# EasyEDA Pro project Dex_split.eprj, board lets_go (continued)
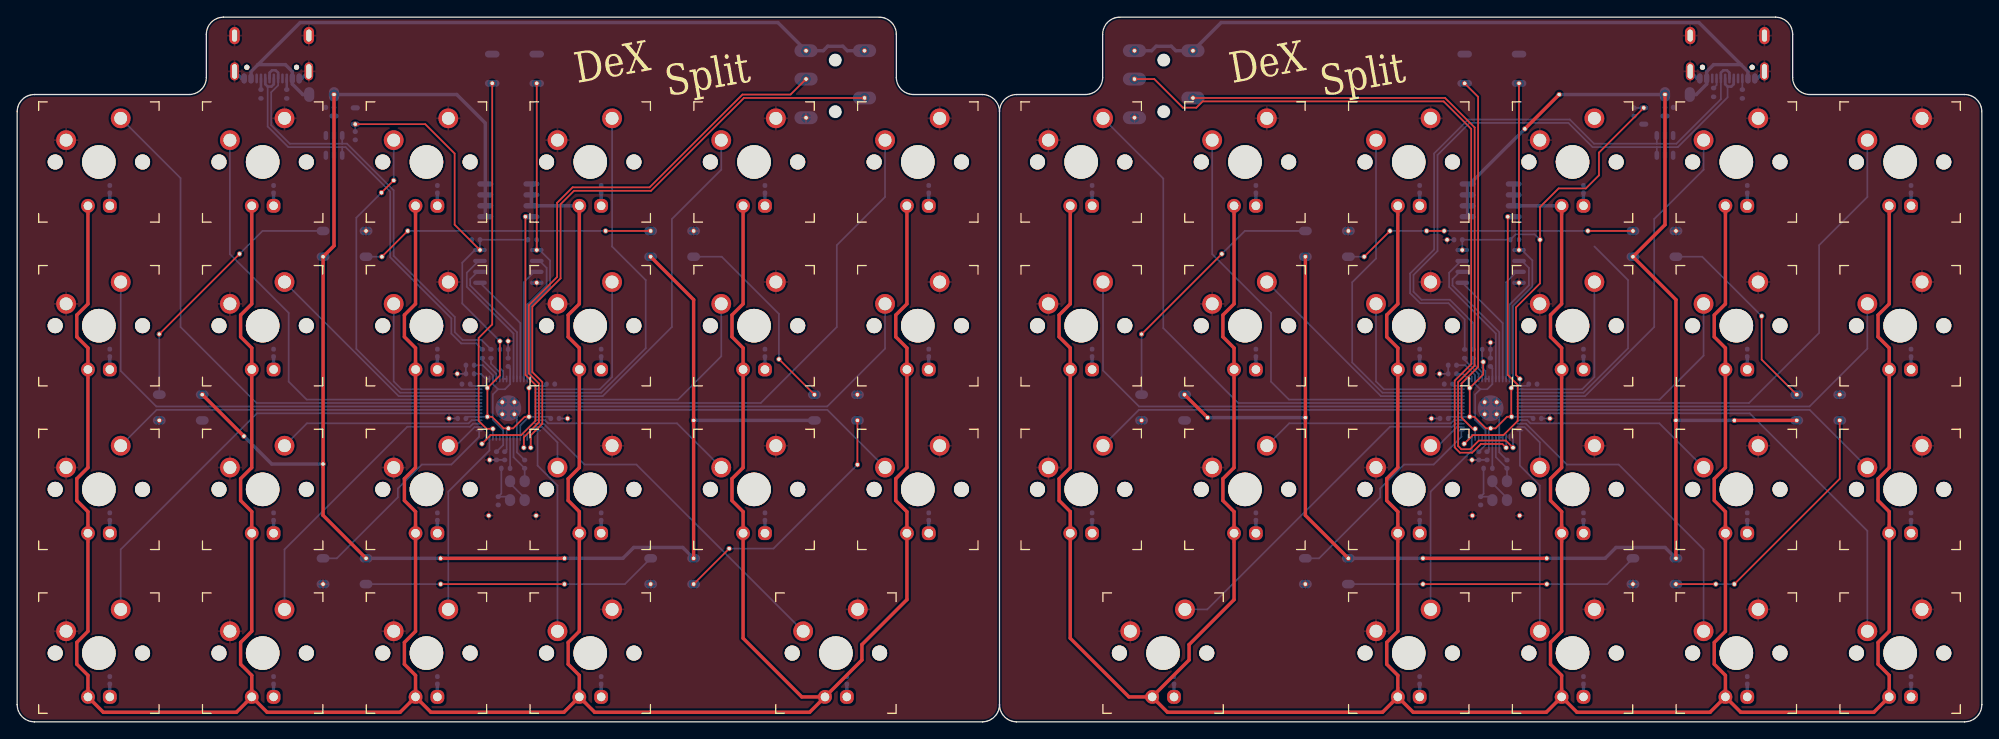
[diagram p0: board, top side]
## Placement (name value [footprint] x y rotation side) (continued)
R40  500Ω  [R0402]  48.87 4.83 270 bottom
R41  500Ω  [R0402]  67.92 4.83 270 bottom
R42  500Ω  [R0402]  96.5 4.83 270 bottom
R50  500Ω  [R0402]  220.27 61.98 270 bottom
R51  500Ω  [R0402]  201.22 61.98 270 bottom
R52  500Ω  [R0402]  182.17 61.98 270 bottom
R53  500Ω  [R0402]  163.12 61.98 270 bottom
R54  500Ω  [R0402]  144.07 61.98 270 bottom
R55  500Ω  [R0402]  125.02 61.98 270 bottom
R56  500Ω  [R0402]  220.27 42.93 270 bottom
R57  500Ω  [R0402]  201.22 42.93 270 bottom
R58  500Ω  [R0402]  182.17 42.93 270 bottom
R59  500Ω  [R0402]  163.12 42.93 270 bottom
R60  500Ω  [R0402]  144.07 42.93 270 bottom
R61  500Ω  [R0402]  125.02 42.93 270 bottom
R62  500Ω  [R0402]  220.27 23.88 270 bottom
R63  500Ω  [R0402]  201.22 23.88 270 bottom
R64  500Ω  [R0402]  182.17 23.88 270 bottom
R65  500Ω  [R0402]  163.12 23.88 270 bottom
R66  500Ω  [R0402]  144.07 23.88 270 bottom
R67  500Ω  [R0402]  125.02 23.88 270 bottom
R68  500Ω  [R0402]  220.27 4.83 270 bottom
R69  500Ω  [R0402]  201.22 4.83 270 bottom
R70  500Ω  [R0402]  182.17 4.83 270 bottom
R71  500Ω  [R0402]  163.12 4.83 270 bottom
R72  500Ω  [R0402]  134.54 4.83 270 bottom
RMX_SW1  -  [CHERRY_MX_MILMAX]  219 65.15 0 top
RMX_SW2  -  [CHERRY_MX_MILMAX]  199.95 65.15 0 top
RMX_SW3  -  [CHERRY_MX_MILMAX]  180.9 65.15 0 top
RMX_SW4  -  [CHERRY_MX_MILMAX]  161.85 65.15 0 top
RMX_SW5  -  [CHERRY_MX_MILMAX]  142.8 65.15 0 top
RMX_SW6  -  [CHERRY_MX_MILMAX]  123.75 65.15 0 top
RMX_SW7  -  [CHERRY_MX_MILMAX]  219 46.1 0 top
RMX_SW8  -  [CHERRY_MX_MILMAX]  199.95 46.1 0 top
RMX_SW9  -  [CHERRY_MX_MILMAX]  180.9 46.1 0 top
RMX_SW10  -  [CHERRY_MX_MILMAX]  161.85 46.1 0 top
RMX_SW11  -  [CHERRY_MX_MILMAX]  142.8 46.1 0 top
RMX_SW12  -  [CHERRY_MX_MILMAX]  123.75 46.1 0 top
RMX_SW13  -  [CHERRY_MX_MILMAX]  219 27.05 0 top
RMX_SW14  -  [CHERRY_MX_MILMAX]  199.95 27.05 0 top
RMX_SW15  -  [CHERRY_MX_MILMAX]  180.9 27.05 0 top
RMX_SW16  -  [CHERRY_MX_MILMAX]  161.85 27.05 0 top
RMX_SW17  -  [CHERRY_MX_MILMAX]  142.8 27.05 0 top
RMX_SW18  -  [CHERRY_MX_MILMAX]  123.75 27.05 0 top
RMX_SW19  -  [CHERRY_MX_MILMAX]  219 8 0 top
RMX_SW20  -  [CHERRY_MX_MILMAX]  199.95 8 0 top
RMX_SW21  -  [CHERRY_MX_MILMAX]  180.9 8 0 top
RMX_SW22  -  [CHERRY_MX_MILMAX]  161.85 8 0 top
RMX_SW23  -  [CHERRY_MX_MILMAX]  133.28 8 0 top
S1  B3U-1000P  [KEY-SMD_B3U-1000PM]  60.42 76 270 bottom
S2  B3U-1000P  [KEY-SMD_B3U-1000PM]  55.25 76 270 bottom
S3  B3U-1000P  [KEY-SMD_B3U-1000PM]  174.68 76 270 bottom
S4  B3U-1000P  [KEY-SMD_B3U-1000PM]  168.35 76 270 bottom
U1  RP2040  [LQFN-56_L7.0-W7.0-P0.4-EP]  171.38 36.5 180 bottom
U2  XC6206P332MR-G  [SOT-23-3_L2.9-W1.6-P1.90-LS2.8-BR]  190.41 70.5 180 bottom
U3  SRV05-4  [SOT-23-6_L2.9-W1.6-P0.95-LS2.8-BL]  191.65 67.08 180 bottom
U4  W25Q128JVSIQ  [SOIC-8_L5.3-W5.3-P1.27-LS8.0-BL]  171.38 53 270 bottom
U5  RP2040  [LQFN-56_L7.0-W7.0-P0.4-EP]  57.12 36.5 180 bottom
U6  SRV05-4  [SOT-23-6_L2.9-W1.6-P0.95-LS2.8-BL]  36.85 67.08 180 bottom
U7  XC6206P332MR-G  [SOT-23-3_L2.9-W1.6-P1.90-LS2.8-BR]  38.08 70.5 0 bottom
U8  W25Q128JVSIQ  [SOIC-8_L5.3-W5.3-P1.27-LS8.0-BL]  57.12 53 270 bottom
Y1  12MHz  [CRYSTAL-SMD_4P-L3.2-W2.5-BL]  58.17 26.9 90 bottom
Y2  12MHz  [CRYSTAL-SMD_4P-L3.2-W2.5-BL]  172.43 26.9 90 bottom

## Footprints (pads in the part's own frame, mm; a bottom-side part is the same pattern mirrored in y, then rotated)
AUDIO-SMD_KH-PJ-327F-SMT
  rrect 1.5x2.7 smd: A(-3.9,3.4) B(-3.9,-3.4) C(1.6,-3.4) D(-0.6,3.4) E(3.9,3.4)
Capacitor_SMD:C_0402_1005Metric
  rrect 0.56x0.62 smd: 1(-0.48,0) 2(0.48,0)
CHERRY_MX_MILMAX
  round 1.75 hole 1.75: 1(-5.08,0) 2(5.08,0)
  round 3.9 hole 3.9: 3(0,0)
  round 2.3 hole 1.5: 4(2.54,5.08) 5(-3.81,2.54)
  round 1.6 hole 1: 6(-1.27,-5.1)
  rrect 1.6x1.6 hole 1: 7(1.27,-5.1)
Connector_USB:USB_C_Receptacle_Palconn_UTC16-G
  round 0.6 hole 0.6: (-2.89,1.33) (2.89,1.33)
  rrect 0.6x1.16 smd: A1(-3.2,2.63) A4(-2.4,2.63) A9(2.4,2.63) A12(3.2,2.63) B1(3.2,2.63) B9(-2.4,2.63) B9(2.4,2.63) B12(-3.2,2.63)
  rrect 0.3x1.16 smd: A5(-1.25,2.63) A6(-0.25,2.63) A7(0.25,2.63) A8(1.25,2.63) B5(1.75,2.63) B6(0.75,2.63) B7(-0.75,2.63) B8(-1.75,2.63)
  oval 1.2x2 hole 0.6x1.4: S1(-4.32,-2.36) S1(4.32,-2.36)
  oval 1x2.1 hole 0.6x1.7: S1(-4.32,1.81) S1(4.32,1.81)
CRYSTAL-SMD_4P-L3.2-W2.5-BL
  rrect 1.4x1.2 smd: 1(-1.1,-0.85) 2(1.1,-0.85) 3(1.1,0.85) 4(-1.1,0.85)
F1206
  rrect 1.19x1.728 smd: 1(-1.445,0) 2(1.445,0)
KEY-SMD_B3U-1000PM
  rrect 0.8x1.7 smd: 1(-1.7,0) 2(1.7,0)
LED-SMD_4P-L5.0-W5.0-BL_XL-5050RGBC
  rrect 1x1.5 smd: 1(-1.5,-2.5) 2(1.5,-2.5) 3(1.5,2.5) 4(-1.5,2.5)
LQFN-56_L7.0-W7.0-P0.4-EP
  rrect 0.8x0.2 smd: 1(-3.4,2.6) 2(-3.4,2.2) 3(-3.4,1.8) 4(-3.4,1.4) 5(-3.4,1) 6(-3.4,0.6) 7(-3.4,0.2) 8(-3.4,-0.2) 9(-3.4,-0.6) 10(-3.4,-1) 11(-3.4,-1.4) 12(-3.4,-1.8) 13(-3.4,-2.2) 14(-3.4,-2.6) 29(3.4,-2.6) 30(3.4,-2.2) 31(3.4,-1.8) 32(3.4,-1.4) 33(3.4,-1) 34(3.4,-0.6) 35(3.4,-0.2) 36(3.4,0.2) 37(3.4,0.6) 38(3.4,1) 39(3.4,1.4) 40(3.4,1.8) 41(3.4,2.2) 42(3.4,2.6)
  rrect 0.2x0.8 smd: 15(-2.6,-3.4) 16(-2.2,-3.4) 17(-1.8,-3.4) 18(-1.4,-3.4) 19(-1,-3.4) 20(-0.6,-3.4) 21(-0.2,-3.4) 22(0.2,-3.4) 23(0.6,-3.4) 24(1,-3.4) 25(1.4,-3.4) 26(1.8,-3.4) 27(2.2,-3.4) 28(2.6,-3.4) 43(2.6,3.4) 44(2.2,3.4) 45(1.8,3.4) 46(1.4,3.4) 47(1,3.4) 48(0.6,3.4) 49(0.2,3.4) 50(-0.2,3.4) 51(-0.6,3.4) 52(-1,3.4) 53(-1.4,3.4) 54(-1.8,3.4) 55(-2.2,3.4) 56(-2.6,3.4)
  rrect 3x3 smd: 57(0,0)
Pad_e56
  round 0.6 hole 0.4: 1(0,0)
Pad_e57
  round 0.6 hole 0.4: 2(0,0)
Pad_e58
  round 0.6 hole 0.4: 3(0,0)
Pad_e59
  round 0.6 hole 0.4: 4(0,0)
Pad_e60
  round 0.6 hole 0.4: 1(0,0)
Pad_e61
  round 0.6 hole 0.4: 2(0,0)
Pad_e62
  round 0.6 hole 0.4: 3(0,0)
Pad_e63
  round 0.6 hole 0.4: 4(0,0)
Pad_e65
  round 0.6 hole 0.4: 1(0,0)
Pad_e66
  round 0.6 hole 0.4: 2(0,0)
Pad_e75
  round 0.6 hole 0.4: 5(0,0)
Pad_e76
  round 0.6 hole 0.4: 6(0,0)
Pad_e77
  round 0.6 hole 0.4: 7(0,0)
Pad_e78
  round 0.6 hole 0.4: 8(0,0)
Pad_e79
  round 0.6 hole 0.4: 9(0,0)
Pad_e80
  round 0.6 hole 0.4: 10(0,0)
Pad_e81
  round 0.6 hole 0.4: 11(0,0)
Pad_e84
  round 0.6 hole 0.4: 12(0,0)
Pad_e88
  round 0.6 hole 0.4: 1(0,0)
Pad_e187
  round 0.6 hole 0.4: 1(0,0)
Pad_e204
  round 0.6 hole 0.4: 1(0,0)
Pad_e280
  round 0.6 hole 0.4: 1(0,0)
Pad_e307
  round 0.6 hole 0.4: 1(0,0)
Pad_e310
  round 0.6 hole 0.4: 4(0,0)
Pad_e314
  round 0.6 hole 0.4: 1(0,0)
Pad_e331
  round 0.6 hole 0.4: 1(0,0)
Pad_e333
  round 0.6 hole 0.4: 1(0,0)
Pad_e335
  round 0.6 hole 0.4: 1(0,0)
Pad_e339
  round 0.6 hole 0.4: 1(0,0)
Pad_e340
  round 0.6 hole 0.4: 2(0,0)
Pad_e341
  round 0.6 hole 0.4: 1(0,0)
Pad_e343
  round 0.6 hole 0.4: 3(0,0)
Pad_e344
  round 0.6 hole 0.4: 1(0,0)
Pad_e345
  round 0.6 hole 0.4: 1(0,0)
Pad_e346
  round 0.6 hole 0.4: 4(0,0)
Pad_e348
  round 0.6 hole 0.4: 5(0,0)
Pad_e352
  round 0.6 hole 0.4: 6(0,0)
Pad_e353
  round 0.6 hole 0.4: 7(0,0)
Pad_e354
  round 0.6 hole 0.4: 8(0,0)
Pad_e355
  round 0.6 hole 0.4: 9(0,0)
Pad_e357
  round 0.6 hole 0.4: 1(0,0)
Pad_e359
  round 0.6 hole 0.4: 1(0,0)
Pad_e360
  round 0.6 hole 0.4: 2(0,0)
Pad_e361
  round 0.6 hole 0.4: 1(0,0)
Pad_e362
  round 0.6 hole 0.4: 2(0,0)
Pad_e367
  round 0.6 hole 0.4: 1(0,0)
Pad_e374
  round 0.6 hole 0.4: 4(0,0)
Pad_e375
  round 0.6 hole 0.4: 2(0,0)
Pad_e376
  round 0.6 hole 0.4: 1(0,0)
Pad_e377
  round 0.6 hole 0.4: 3(0,0)
Pad_e381
  round 0.6 hole 0.4: 1(0,0)
Pad_e427
  round 0.6 hole 0.4: 1(0,0)
Pad_e460
  round 0.6 hole 0.4: 1(0,0)
Pad_e500
  round 0.6 hole 0.4: 1(0,0)
Pad_e572
  round 0.6 hole 0.4: 1(0,0)
Pad_e574
  round 0.6 hole 0.4: 2(0,0)
Pad_e597
  round 0.6 hole 0.4: 1(0,0)
Pad_e614
  round 0.6 hole 0.4: 4(0,0)
Pad_e615
  round 0.6 hole 0.4: 1(0,0)
Pad_e616
  round 0.6 hole 0.4: 1(0,0)
Pad_e618
  round 0.6 hole 0.4: 2(0,0)
Pad_e619
  round 0.6 hole 0.4: 3(0,0)
Pad_e621
  round 0.6 hole 0.4: 1(0,0)
Pad_e656
  round 0.6 hole 0.4: 1(0,0)
Pad_e802
  round 0.6 hole 0.4: 1(0,0)
Pad_e819
  round 0.6 hole 0.4: 1(0,0)
Pad_e820
  round 0.6 hole 0.4: 2(0,0)
Pad_e832
  round 0.6 hole 0.4: 2(0,0)
Pad_e848
  round 0.6 hole 0.4: 1(0,0)
Pad_e849
  round 0.6 hole 0.4: 2(0,0)
Pad_e870
  round 0.6 hole 0.4: 1(0,0)
Pad_e885
  round 0.6 hole 0.36: 1(0,0)
Pad_e988
  round 0.6 hole 0.4: 1(0,0)
Pad_e1288
  round 0.6 hole 0.4: 1(0,0)
Pad_e1300
  round 0.6 hole 0.4: 1(0,0)
Pad_e1359
  round 0.6 hole 0.4: 1(0,0)
Pad_e1412
  round 0.6 hole 0.4: 1(0,0)
Pad_e1417
  round 0.6 hole 0.4: 1(0,0)
Pad_e1443
  round 0.6 hole 0.4: 1(0,0)
Pad_e1468
  round 0.6 hole 0.4: 1(0,0)
Pad_e1560
  round 0.6 hole 0.4: 1(0,0)
Pad_e1562
  round 0.6 hole 0.4: 1(0,0)
Pad_e1563
  round 0.6 hole 0.4: 2(0,0)
Pad_e1674
  round 0.6 hole 0.4: 1(0,0)
Pad_e1687
  round 0.6 hole 0.4: 1(0,0)
Pad_e1703
  round 0.6 hole 0.4: 1(0,0)
Pad_e1706
  round 0.6 hole 0.4: 1(0,0)
Pad_e1708
  round 0.6 hole 0.4: 4(0,0)
Pad_e1715
  round 0.6 hole 0.4: 1(0,0)
Pad_e1744
  round 0.6 hole 0.4: 1(0,0)
Pad_e1745
  round 0.6 hole 0.4: 2(0,0)
Pad_e1749
  round 0.6 hole 0.4: 1(0,0)
Pad_e1750
  round 0.6 hole 0.4: 2(0,0)
Pad_e1764
  round 0.6 hole 0.4: 1(0,0)
Pad_e1796
  round 0.6 hole 0.4: 1(0,0)
Pad_e1802
  round 0.6 hole 0.4: 1(0,0)
Pad_e1814
  round 0.6 hole 0.4: 1(0,0)
Pad_e1864
  round 0.6 hole 0.4: 1(0,0)
Pad_e1868
  round 0.6 hole 0.4: 1(0,0)
Pad_e1871
  round 0.6 hole 0.36: 1(0,0)
Pad_e1880
  round 0.6 hole 0.4: 1(0,0)
Pad_e1893
  round 0.6 hole 0.4: 1(0,0)
Pad_e1901
  round 0.6 hole 0.4: 2(0,0)
Pad_e1903
  round 0.6 hole 0.4: 1(0,0)
Pad_e1905
  round 0.6 hole 0.4: 2(0,0)
Pad_e1923
  round 0.6 hole 0.4: 1(0,0)
Pad_e1930
  round 0.6 hole 0.4: 2(0,0)
Pad_e2258
  round 0.6 hole 0.4: 1(0,0)
Pad_e2261
  round 0.6 hole 0.4: 1(0,0)
Pad_e2272
  round 0.6 hole 0.4: 1(0,0)
Pad_e2373
  round 0.6 hole 0.4: 1(0,0)
Pad_e2408
  round 0.6 hole 0.4: 1(0,0)
Pad_e2578
  round 0.6 hole 0.4: 1(0,0)
Pad_e2582
  round 0.6 hole 0.4: 1(0,0)
Pad_e2584
  round 0.6 hole 0.4: 1(0,0)
Pad_e2596
  round 0.6 hole 0.4: 1(0,0)
Pad_e2623
  round 0.6 hole 0.4: 1(0,0)
Pad_e2624
  round 0.6 hole 0.4: 2(0,0)
Pad_e2638
  round 0.6 hole 0.4: 1(0,0)
Pad_e2646
  round 0.6 hole 0.4: 1(0,0)
Pad_e2695
  round 0.6 hole 0.4: 1(0,0)
Pad_e2696
  round 0.6 hole 0.4: 1(0,0)
Pad_e2711
  round 0.6 hole 0.4: 1(0,0)
Pad_e2716
  round 0.6 hole 0.4: 1(0,0)
Pad_e2729
  round 0.6 hole 0.4: 1(0,0)
Pad_e2732
  round 0.6 hole 0.4: 1(0,0)
Pad_e3129
  round 0.6 hole 0.4: 1(0,0)
Pad_e3859
  round 0.6 hole 0.4: 1(0,0)
Pad_e3877
  round 0.6 hole 0.4: 1(0,0)
Pad_e3885
  round 0.6 hole 0.4: 1(0,0)
Pad_e3918
  round 0.6 hole 0.4: 1(0,0)
Pad_e3920
  round 0.6 hole 0.4: 1(0,0)
Pad_e3922
  round 0.6 hole 0.4: 1(0,0)
Pad_e3923
  round 0.6 hole 0.4: 1(0,0)
Pad_e3924
  round 0.6 hole 0.4: 1(0,0)
Pad_e3925
  round 0.6 hole 0.4: 1(0,0)
Pad_e3930
  round 0.6 hole 0.4: 1(0,0)
Pad_e3943
  round 0.6 hole 0.4: 1(0,0)
Pad_e3976
  round 0.6 hole 0.4: 1(0,0)
R0402
  rrect 0.566x0.54 smd: 1(-0.433,0) 2(0.433,0)
Resistor_SMD:R_0402_1005Metric
  rrect 0.54x0.64 smd: 1(-0.51,0) 2(0.51,0)
SOIC-8_L5.3-W5.3-P1.27-LS8.0-BL
  rrect 0.5x1.6 smd: 1(-1.905,-3.3) 2(-0.635,-3.3) 3(0.635,-3.3) 4(1.905,-3.3) 5(1.905,3.3) 6(0.635,3.3) 7(-0.635,3.3) 8(-1.905,3.3)
SOP-8_L4.9-W3.9-P1.27-LS6.0-BL
  oval 0.63x1.865 smd: 1(-1.905,-2.683) 2(-0.635,-2.683) 3(0.635,-2.683) 4(1.905,-2.683) 5(1.905,2.683) 6(0.635,2.683) 7(-0.635,2.683) 8(-1.905,2.683)
SOT-23-3_L2.9-W1.6-P1.90-LS2.8-BR
  rrect 1.07x0.6 smd: 1(1.235,-0.95) 2(1.235,0.95) 3(-1.235,0)
SOT-23-6_L2.9-W1.6-P0.95-LS2.8-BL
  rrect 0.532x1.072 smd: 1(-0.95,-1.149) 2(0,-1.149) 3(0.95,-1.149) 4(0.95,1.149) 5(0,1.149) 6(-0.95,1.149)

## Nets
+1V1: C4.1 C5.1 C13.1 C14.1 C59.1 C66.1 U1.23 U1.45 U1.50 U5.23 U5.45 U5.50
+3V3: C2.1 C6.1 C7.1 C8.1 C9.1 C12.1 C16.1 C17.1 C18.1 C19.1 C23.1 C24.1 C60.1 C61.1 C62.1 C63.1 C64.1 C65.1 NOREF.1 NOREF#13.1 NOREF#16.1 NOREF#25.2 NOREF#34.1 NOREF#35.1 NOREF#36.1 NOREF#45.1 NOREF#60.1 NOREF#77.1 NOREF#80.1 NOREF#84.1 NOREF#85.1 NOREF#105.1 NOREF#115.1 NOREF#125.1 NOREF#130.1 NOREF#131.1 R8.1 R17.1 U1.1 U1.10 U1.22 U1.33 U1.42 U1.43 U1.44 U1.48 U1.49 U2.2 U4.8 U5.1 U5.10 U5.18 U5.22 U5.33 U5.42 U5.43 U5.44 U5.48 U5.49 U7.2 U8.8
+5V: C1.1 C20.1 D1.1 D2.1 D3.1 D4.1 D5.1 D6.1 D7.1 D8.1 D9.1 D10.1 D11.1 D12.1 F1.2 F3.2 LMX_SW1.6 LMX_SW2.6 LMX_SW3.6 LMX_SW4.6 LMX_SW5.6 LMX_SW6.6 LMX_SW7.6 LMX_SW8.6 LMX_SW9.6 LMX_SW10.6 LMX_SW11.6 LMX_SW12.6 LMX_SW13.6 LMX_SW14.6 LMX_SW15.6 LMX_SW16.6 LMX_SW17.6 LMX_SW18.6 LMX_SW19.6 LMX_SW20.6 LMX_SW21.6 LMX_SW22.6 LMX_SW23.6 NOREF#2.7 NOREF#8.1 NOREF#14.1 NOREF#21.1 NOREF#22.2 NOREF#23.11 NOREF#24.1 NOREF#26.2 NOREF#28.1 NOREF#30.5 NOREF#40.8 NOREF#53.1 NOREF#55.1 NOREF#58.1 NOREF#63.1 NOREF#64.6 NOREF#67.10 NOREF#78.1 NOREF#82.3 NOREF#91.1 NOREF#100.9 NOREF#101.4 NOREF#102.1 NOREF#124.1 NOREF#129.12 NOREF#132.1 Q1.1 Q1.2 Q1.3 Q1.5 Q1.6 Q1.7 Q1.8 Q2.1 Q2.2 Q2.3 Q2.5 Q2.6 Q2.7 Q2.8 RMX_SW1.6 RMX_SW2.6 RMX_SW3.6 RMX_SW4.6 RMX_SW5.6 RMX_SW6.6 RMX_SW7.6 RMX_SW8.6 RMX_SW9.6 RMX_SW10.6 RMX_SW11.6 RMX_SW12.6 RMX_SW13.6 RMX_SW14.6 RMX_SW15.6 RMX_SW16.6 RMX_SW17.6 RMX_SW18.6 RMX_SW19.6 RMX_SW20.6 RMX_SW21.6 RMX_SW22.6 RMX_SW23.6 U2.3 U3.5 U6.5 U7.3
GND: C1.2 C2.2 C4.2 C5.2 C6.2 C7.2 C8.2 C9.2 C10.1 C11.1 C12.2 C13.2 C14.2 C16.2 C17.2 C18.2 C19.2 C20.2 C21.1 C22.1 C23.2 C24.2 C59.2 C60.2 C61.2 C62.2 C63.2 C64.2 C65.2 C66.2 D1.3 D2.3 D3.3 D4.3 D5.3 D6.3 D7.3 D8.3 D9.3 D10.3 D11.3 D12.3 J1.A1 J1.A12 J1.B1 J1.B12 J1.S1 J2.A1 J2.A12 J2.B1 J2.B12 J2.S1 LMX_SW1.5 LMX_SW2.4 LMX_SW3.4 LMX_SW4.5 LMX_SW5.4 LMX_SW6.4 LMX_SW7.5 LMX_SW8.5 LMX_SW9.4 LMX_SW10.5 LMX_SW11.4 LMX_SW12.4 LMX_SW13.5 LMX_SW14.5 LMX_SW15.5 LMX_SW16.4 LMX_SW17.4 LMX_SW18.4 LMX_SW19.5 LMX_SW20.5 LMX_SW21.5 LMX_SW22.4 LMX_SW23.4 NOREF#3.5 NOREF#9.1 NOREF#11.1 NOREF#17.2 NOREF#20.1 NOREF#31.1 NOREF#32.4 NOREF#33.3 NOREF#41.1 NOREF#46.1 NOREF#49.2 NOREF#54.1 NOREF#68.1 NOREF#70.3 NOREF#74.1 NOREF#76.4 NOREF#79.1 NOREF#81.1 NOREF#83.1 NOREF#87.1 NOREF#89.1 NOREF#95.1 NOREF#98.1 NOREF#110.1 NOREF#113.1 NOREF#114.1 NOREF#117.2 NOREF#118.3 NOREF#120.1 NOREF#121.1 NOREF#122.1 NOREF#126.1 NOREF#127.2 NOREF#128.1 NOREF#133.1 NOREF#135.4 NOREF#136.1 NOREF#137.1 NOREF#139.2 P1.E P2.E R1.2 R2.2 R12.2 R13.2 R20.1 R21.1 R22.1 R23.1 R24.1 R25.1 R26.1 R27.1 R28.1 R29.1 R30.1 R31.1 R32.1 R33.1 R34.1 R35.1 R36.1 R37.1 R38.1 R39.1 R40.1 R41.1 R42.1 R50.1 R51.1 R52.1 R53.1 R54.1 R55.1 R56.1 R57.1 R58.1 R59.1 R60.1 R61.1 R62.1 R63.1 R64.1 R65.1 R66.1 R67.1 R68.1 R69.1 R70.1 R71.1 R72.1 RMX_SW1.4 RMX_SW2.4 RMX_SW3.5 RMX_SW4.4 RMX_SW5.4 RMX_SW6.5 RMX_SW7.4 RMX_SW8.4 RMX_SW9.5 RMX_SW10.4 RMX_SW11.5 RMX_SW12.5 RMX_SW13.4 RMX_SW14.4 RMX_SW15.4 RMX_SW16.5 RMX_SW17.5 RMX_SW18.5 RMX_SW19.4 RMX_SW20.4 RMX_SW21.4 RMX_SW22.5 RMX_SW23.5 S1.1 S2.1 S3.1 S4.1 U1.18 U1.19 U1.57 U2.1 U3.1 U3.2 U3.6 U4.4 U5.19 U5.57 U6.2 U6.3 U6.4 U7.1 U8.4 Y1.2 Y1.4 Y2.2 Y2.4
VBUS: F1.1 F3.1 J1.A4 J1.A9 J1.B9 J2.A4 J2.A9 J2.B9 NOREF#51.1 NOREF#52.3 NOREF#94.2 NOREF#107.4 P1.A P1.B P2.A P2.B
L_D+: J1.A6 J1.B6 R10.1 U6.6
L_D-: J1.A7 J1.B7 R11.1 U6.1
L_USB_DM: R11.2 U5.46
LED_GATE: NOREF#37.1 NOREF#44.1 NOREF#92.1 NOREF#123.1 Q1.4 Q2.4 U1.28 U5.28
LED_SIG: D3.4 D9.4 U1.29 U5.29
LEDGND: LMX_SW1.7 LMX_SW2.7 LMX_SW3.7 LMX_SW4.7 LMX_SW5.7 LMX_SW6.7 LMX_SW7.7 LMX_SW8.7 LMX_SW9.7 LMX_SW10.7 LMX_SW11.7 LMX_SW12.7 LMX_SW13.7 LMX_SW14.7 LMX_SW15.7 LMX_SW16.7 LMX_SW17.7 LMX_SW18.7 LMX_SW19.7 LMX_SW20.7 LMX_SW21.7 LMX_SW22.7 LMX_SW23.7 R20.2 R21.2 R22.2 R23.2 R24.2 R25.2 R26.2 R27.2 R28.2 R29.2 R30.2 R31.2 R32.2 R33.2 R34.2 R35.2 R36.2 R37.2 R38.2 R39.2 R40.2 R41.2 R42.2 R50.2 R51.2 R52.2 R53.2 R54.2 R55.2 R56.2 R57.2 R58.2 R59.2 R60.2 R61.2 R62.2 R63.2 R64.2 R65.2 R66.2 R67.2 R68.2 R69.2 R70.2 R71.2 R72.2 RMX_SW1.7 RMX_SW2.7 RMX_SW3.7 RMX_SW4.7 RMX_SW5.7 RMX_SW6.7 RMX_SW7.7 RMX_SW8.7 RMX_SW9.7 RMX_SW10.7 RMX_SW11.7 RMX_SW12.7 RMX_SW13.7 RMX_SW14.7 RMX_SW15.7 RMX_SW16.7 RMX_SW17.7 RMX_SW18.7 RMX_SW19.7 RMX_SW20.7 RMX_SW21.7 RMX_SW22.7 RMX_SW23.7
LMX1: LMX_SW1.4 U5.37
LMX2: LMX_SW2.5 U5.38
LMX3: LMX_SW3.5 NOREF#97.1 NOREF#99.1 U5.40
LMX4: LMX_SW4.4 U5.3
LMX5: LMX_SW5.5 U5.4
LMX6: LMX_SW6.5 U5.6
LMX7: LMX_SW7.4 U5.36
LMX8: LMX_SW8.4 U5.39
LMX9: LMX_SW9.5 U5.41
LMX10: LMX_SW10.4 U5.2
LMX11: LMX_SW11.5 U5.5
LMX12: LMX_SW12.5 U5.7
LMX13: LMX_SW13.4 U5.35
LMX14: LMX_SW14.4 U5.32
LMX15: LMX_SW15.4 U5.30
LMX16: LMX_SW16.5 U5.13
LMX17: LMX_SW17.5 U5.11
LMX18: LMX_SW18.5 U5.8
LMX19: LMX_SW19.4 U5.34
LMX20: LMX_SW20.4 U5.31
LMX21: LMX_SW21.4 U5.27
LMX22: LMX_SW22.5 U5.14
LMX23: LMX_SW23.5 U5.12
LS1: D3.2 D4.4 D9.2 D10.4 NOREF#7.1 NOREF#10.1 NOREF#15.4 NOREF#106.4
LS2: D4.2 D5.4 D10.2 D11.4 NOREF#19.1 NOREF#27.1 NOREF#29.1 NOREF#48.2 NOREF#59.2 NOREF#61.1 NOREF#86.1 NOREF#134.1
LS3: D5.2 D6.4 D11.2 D12.4 NOREF#4.1 NOREF#39.1 NOREF#119.1 NOREF#138.1
LS4: D1.4 D6.2 D7.4 D12.2 NOREF#12.2 NOREF#38.1 NOREF#47.2 NOREF#50.2 NOREF#56.1 NOREF#66.2 NOREF#73.1 NOREF#93.2 NOREF#109.1 NOREF#116.1
LS5: D1.2 D2.4 D7.2 D8.4 NOREF#72.1 NOREF#90.1 NOREF#104.1 NOREF#112.1
LS6: D2.2 D8.2
NET-(C10-PAD2): C10.2 R6.1 Y2.1
NET-(C22-PAD2): C22.2 R16.1 Y1.1
NET-(J9-PADA5): J1.A5 J2.A5 R1.1 R12.1
NET-(J9-PADB5): J1.B5 J2.B5 R2.1 R13.1
QCLK_L: U1.52 U4.6
QCLK_R: U5.52 U8.6
QIO0_L: U1.53 U4.5
QIO0_R: U5.53 U8.5
QIO1_L: U1.55 U4.2
QIO1_R: U5.55 U8.2
QIO2_L: U1.54 U4.3
QIO2_R: U5.54 U8.3
QIO3_L: U1.51 U4.7
QIO3_R: U5.51 U8.7
QSEL_L: NOREF#69.1 NOREF#96.2 R8.2 S3.2 U1.56 U4.1
QSEL_R: NOREF#57.1 NOREF#62.1 R17.2 S1.2 U5.56 U8.1
R_D+: J2.A6 J2.B6 R4.1 U3.3
R_D-: J2.A7 J2.B7 R5.1 U3.4
R_USB_DM: R5.2 U1.46
R_USB_DP: R4.2 R10.2 U1.47 U5.47
RESET_L: NOREF#71.1 NOREF#88.1 S4.2 U1.26
RESET_R: NOREF#6.1 NOREF#103.1 S2.2 U5.26
RMX1: RMX_SW1.5 U1.6
RMX2: RMX_SW2.5 U1.4
RMX3: RMX_SW3.4 U1.3
RMX4: RMX_SW4.5 U1.40
RMX5: RMX_SW5.5 U1.38
RMX6: RMX_SW6.4 U1.37
RMX7: RMX_SW7.5 U1.7
RMX8: RMX_SW8.5 U1.5
RMX9: RMX_SW9.4 U1.2
RMX10: RMX_SW10.5 U1.41
RMX11: RMX_SW11.4 U1.39
RMX12: RMX_SW12.4 U1.36
RMX13: RMX_SW13.5 U1.8
RMX14: RMX_SW14.5 U1.11
RMX15: RMX_SW15.5 U1.13
RMX16: RMX_SW16.4 U1.30
RMX17: RMX_SW17.4 U1.32
RMX18: RMX_SW18.4 U1.35
RMX19: RMX_SW19.5 U1.9
RMX20: RMX_SW20.5 U1.12
RMX21: RMX_SW21.5 U1.14
RMX22: RMX_SW22.4 U1.27
RMX23: RMX_SW23.4 U1.31
RX: NOREF#42.2 NOREF#75.2 NOREF#108.6 NOREF#111.9 P1.C P2.C U1.15 U5.15
TX: NOREF#5.7 NOREF#18.8 NOREF#43.1 NOREF#65.1 P1.D P2.D U1.17 U5.17
XIN_L: C11.2 U1.20 Y2.3
XIN_R: C21.2 U5.20 Y1.3
XOUT_L: R6.2 U1.21
XOUT_R: R16.2 U5.21

Pads without a net: J1 A8 B8; J2 A8 B8; LMX_SW1 1 2 3; LMX_SW2 1 2 3; LMX_SW3 1 2 3; LMX_SW4 1 2 3; LMX_SW5 1 2 3; LMX_SW6 1 2 3; LMX_SW7 1 2 3; LMX_SW8 1 2 3; LMX_SW9 1 2 3; LMX_SW10 1 2 3; LMX_SW11 1 2 3; LMX_SW12 1 2 3; LMX_SW13 1 2 3; LMX_SW14 1 2 3; LMX_SW15 1 2 3; LMX_SW16 1 2 3; LMX_SW17 1 2 3; LMX_SW18 1 2 3; LMX_SW19 1 2 3; LMX_SW20 1 2 3; LMX_SW21 1 2 3; LMX_SW22 1 2 3; LMX_SW23 1 2 3; RMX_SW1 1 2 3; RMX_SW2 1 2 3; RMX_SW3 1 2 3; RMX_SW4 1 2 3; RMX_SW5 1 2 3; RMX_SW6 1 2 3; RMX_SW7 1 2 3; RMX_SW8 1 2 3; RMX_SW9 1 2 3; RMX_SW10 1 2 3; RMX_SW11 1 2 3; RMX_SW12 1 2 3; RMX_SW13 1 2 3; RMX_SW14 1 2 3; RMX_SW15 1 2 3; RMX_SW16 1 2 3; RMX_SW17 1 2 3; RMX_SW18 1 2 3; RMX_SW19 1 2 3; RMX_SW20 1 2 3; RMX_SW21 1 2 3; RMX_SW22 1 2 3; RMX_SW23 1 2 3; U1 16 24 25 34; U5 9 16 24 25

## Routing (per net, layer and track width the routed paths; a pad name or vN(x,y) marks a point on that pad's centre or on a via; arc(x,y) is an arc through that point)
+1V1: length 33.3
  Bottom Layer w0.2: C5.1 171.57,41.14 U1.50 171.57,39.3 170.98,38.7 170.17,38.7 ; 55.92,38.7 55.33,39.3 U5.45 55.33,40.33 54.15,41.5 C13.1 ; 55.92,38.7 56.73,38.7 57.33,39.3 U5.50 57.33,41.14 C14.1 ; 55.92,38.7 55.32,38.1 55.32,35.15 56.53,33.94 U5.23 56.53,32.21 C66.1 ; 170.17,38.7 169.57,39.3 U1.45 169.57,40.33 168.4,41.5 C4.1 ; 170.17,38.7 169.57,38.1 169.57,35.15 170.78,33.94 U1.23 170.78,32.21 C59.1
+3V3: length 176.1
  Top Layer w0.2: NOREF#77.1 170.51,40.42 NOREF#84.1 NOREF#45.1 169.47,35.5 170.82,34.15 NOREF#105.1 171.93,34.15 173.28,35.5 173.78,35.5 NOREF#60.1 ; NOREF#125.1 NOREF#85.1 ; NOREF#125.1 59.03,35.5 57.68,34.15 NOREF#115.1 56.57,34.15 55.22,35.5 NOREF#34.1 NOREF#130.1 56.14,40.3 NOREF#13.1 ; NOREF#125.1 59.56,35.5 ; NOREF.1 183.97,66.24 183.97,63.59 182.45,62.07 179.27,62.07 177.12,59.91 177.12,51.02 174.32,48.23 174.32,40.35 NOREF#36.1 ; NOREF#131.1 47.46,69.55 50.88,66.14 50.88,57.85 NOREF#35.1
  Bottom Layer w0.2: U1.49 U1.48 170.78,40.82 170.39,41.21 C8.1 ; C7.1 175.61,39.1 U1.1 ; C62.1 168.18,40.5 U1.43 ; U1.1 174.03,39.1 NOREF#60.1 ; U1.1 NOREF#36.1 ; C60.1 166.64,35.5 U1.33 NOREF#45.1 ; NOREF#80.1 U1.10 176.11,35.5 C61.1 ; NOREF#115.1 56.92,33.95 U5.22 56.92,31.66 C63.1 ; NOREF#34.1 U5.33 52.39,35.5 C19.1 ; NOREF#131.1 C23.1 ; C65.1 61.36,39.1 U5.1 59.78,39.1 NOREF#85.1 ; C18.1 53.92,40.5 U5.43 ; U1.44 U1.43 ; U1.43 168.78,39.02 168.69,39.1 U1.42 167.14,39.1 C6.1 ; U5.43 U5.44 ; U5.43 54.53,39.02 54.44,39.1 U5.42 52.89,39.1 C16.1 ; NOREF#25.2 C12.1 R8.1 174.28,56.72 176.49,56.72 NOREF#16.1 ; C9.1 171.18,31.66 U1.22 171.18,33.95 NOREF#105.1 ; U5.49 U5.48 56.53,40.82 56.14,41.21 C17.1 NOREF#13.1 51.77,48.67 51.77,53.44 53.24,54.91 NOREF#35.1 C24.1 R17.1 ; C2.1 NOREF.1 ; C64.1 61.86,35.5 U5.10 NOREF#125.1 58.53,34.5 58.53,33.27
+5V: length 1336.6
  Top Layer w0.4: NOREF#55.1 36.85,55.4 NOREF#132.1 35.58,24.03 NOREF#82.3 ; RMX_SW3.6 179.63,48.63 178.33,47.34 178.33,44.8 179.63,43.5 RMX_SW9.6 179.63,29.58 178.33,28.29 178.33,25.75 179.63,24.45 RMX_SW15.6 179.63,10.53 178.33,9.24 178.33,6.7 179.63,5.4 RMX_SW21.6 ; LMX_SW2.6 27.28,48.63 25.98,47.34 25.98,44.8 27.28,43.5 LMX_SW8.6 27.28,29.58 25.98,28.29 25.98,25.75 27.28,24.45 LMX_SW14.6 27.28,10.53 25.98,9.24 25.98,6.7 27.28,5.4 LMX_SW20.6 ; RMX_SW22.6 158.79,1.11 133.79,1.11 RMX_SW23.6 ; RMX_SW22.6 162.37,1.11 177.84,1.11 RMX_SW21.6 ; RMX_SW22.6 160.58,5.4 159.28,6.7 159.28,9.24 160.58,10.53 RMX_SW16.6 160.58,24.45 159.28,25.75 159.28,28.29 160.58,29.58 RMX_SW10.6 160.58,43.5 159.28,44.8 159.28,47.34 160.58,48.63 RMX_SW4.6 ; NOREF#22.2 NOREF#8.1 ; NOREF#2.7 NOREF#53.1 149.82,24.03 NOREF#100.9 ; LMX_SW1.6 8.23,48.63 6.94,47.34 6.94,44.8 8.23,43.5 LMX_SW7.6 8.23,29.58 6.94,28.29 6.94,25.75 8.23,24.45 LMX_SW13.6 8.23,10.53 6.94,9.24 6.94,6.7 8.23,5.4 LMX_SW19.6 10.02,1.11 25.49,1.11 LMX_SW20.6 ; NOREF#58.1 191.65,57.85 NOREF#129.12 192.93,49.12 NOREF#67.10 ; RMX_SW23.6 136.3,7.19 136.3,8.99 141.53,14.22 RMX_SW17.6 141.53,24.45 140.23,25.75 140.23,28.29 141.53,29.58 RMX_SW11.6 141.53,43.5 140.23,44.8 140.23,47.34 141.53,48.63 RMX_SW5.6 ; RMX_SW23.6 129.3,2.9 122.48,9.72 RMX_SW18.6 122.48,24.45 121.19,25.75 121.19,28.29 122.48,29.58 RMX_SW12.6 122.48,43.5 121.19,44.8 121.19,47.34 122.48,48.63 RMX_SW6.6 ; LMX_SW5.6 84.43,48.63 83.14,47.34 83.14,44.8 84.43,43.5 LMX_SW11.6 84.43,29.58 83.14,28.29 83.14,25.75 84.43,24.45 LMX_SW17.6 84.43,9.72 91.25,2.9 93.96,2.9 ; NOREF#14.1 NOREF#102.1 ; 93.96,2.9 98.25,7.19 98.25,8.99 103.48,14.22 LMX_SW18.6 103.48,24.45 102.19,25.75 102.19,28.29 103.48,29.58 LMX_SW12.6 103.48,43.5 102.19,44.8 102.19,47.34 103.48,48.63 LMX_SW6.6 ; 93.96,2.9 92.17,1.11 67.17,1.11 LMX_SW22.6 ; LMX_SW21.6 46.33,5.4 45.03,6.7 45.03,9.24 46.33,10.53 LMX_SW15.6 46.33,24.45 45.03,25.75 45.03,28.29 46.33,29.58 LMX_SW9.6 46.33,43.5 45.03,44.8 45.03,47.34 46.33,48.63 LMX_SW3.6 ; LMX_SW21.6 44.54,1.11 29.07,1.11 LMX_SW20.6 ; LMX_SW21.6 48.12,1.11 63.59,1.11 LMX_SW22.6 ; LMX_SW22.6 65.38,5.4 64.08,6.7 64.08,9.24 65.38,10.53 LMX_SW16.6 65.38,24.45 64.08,25.75 64.08,28.29 65.38,29.58 LMX_SW10.6 65.38,43.5 64.08,44.8 64.08,47.34 65.38,48.63 LMX_SW4.6 ; NOREF#64.6 78.67,49.12 NOREF#30.5 NOREF#101.4 ; NOREF#124.1 NOREF#91.1 ; NOREF#63.1 NOREF#24.1 ; RMX_SW20.6 200.47,1.11 215.94,1.11 RMX_SW19.6 217.73,5.4 216.43,6.7 216.43,9.24 217.73,10.53 RMX_SW13.6 217.73,24.45 216.43,25.75 216.43,28.29 217.73,29.58 RMX_SW7.6 217.73,43.5 216.43,44.8 216.43,47.34 217.73,48.63 RMX_SW1.6 ; RMX_SW20.6 198.68,5.4 197.38,6.7 197.38,9.24 198.68,10.53 RMX_SW14.6 198.68,24.45 197.38,25.75 197.38,28.29 198.68,29.58 RMX_SW8.6 198.68,43.5 197.38,44.8 197.38,47.34 198.68,48.63 RMX_SW2.6 ; RMX_SW20.6 196.89,1.11 181.42,1.11 RMX_SW21.6 ; NOREF#23.11 NOREF#78.1 ; NOREF#40.8 NOREF#21.1
  Bottom Layer w0.4: U3.5 U2.3 C1.1 NOREF#58.1 NOREF#63.1 ; Q1.5 Q1.6 Q1.7 Q1.8 54.44,69.68 51.12,73 NOREF#55.1 C20.1 U7.3 U6.5 ; NOREF#100.9 NOREF#124.1 ; NOREF#53.1 NOREF#21.1 ; NOREF#78.1 NOREF#28.1 ; NOREF#82.3 NOREF#14.1 ; Q2.5 Q2.6 Q2.7 Q2.8 168.93,62.59 NOREF#24.1 ; NOREF#102.1 70.44,19.03 71.7,20.29 77.41,20.29 NOREF#101.4 ; NOREF#30.5 D5.1 ; NOREF#67.10 191.66,20.29 185.95,20.29 184.69,19.03 NOREF#91.1 ; Q1.1 Q1.2 Q1.3 LMX_SW4.6 ; NOREF#26.2 29.6,30 NOREF#8.1 ; RMX_SW3.6 Q2.3 Q2.2 Q2.1
GND: length 39.8
  Bottom Layer w0.2: C4.2 C62.2 NOREF#54.1 ; C5.2 C8.2 NOREF#136.1 ; C63.2 C66.2 NOREF#137.1 ; Y2.4 173.28,26.05 171.57,27.75 171.57,28 ; C21.1 58.12,31.36 U5.19 58.12,35.5 NOREF#135.4 ; C11.1 172.38,31.36 U1.19 ; NOREF#76.4 172.38,35.5 U1.19 ; C12.2 NOREF#113.1 ; 59.03,25.8 59.03,26.05 57.33,27.75 Y1.2 ; NOREF#122.1 C19.2 ; U1.19 U1.18 ; NOREF#114.1 C18.2 C13.2 ; C64.2 NOREF#11.1 ; NOREF#31.1 C17.2 C14.2 ; NOREF#128.1 C60.2 ; NOREF#95.1 C59.2 C9.2 ; NOREF#41.1 C61.2
  Bottom Layer w0.4: J2.S1 202.4,74.87 J2.A12 ; J1.A1 26.1,74.87 J1.S1 ; J1.A12 33.1,74.87 J1.S1 ; J2.A1 195.4,74.87 J2.S1
VBUS: length 169.1
  Bottom Layer w0.4: J1.A4 27.2,75.67 28.01,76.48 ; F3.1 195.28,73 196.5,74.22 J2.A4 196.5,75.67 197.31,76.48 200.49,76.48 ; 28.01,76.48 32.91,81.38 88.47,81.38 NOREF#51.1 93.75,78.1 94.27,78.62 96.03,78.62 96.55,78.1 NOREF#94.2 ; 28.01,76.48 31.19,76.48 32,75.67 J1.A9 32,74.22 33.22,73 F1.1 ; 200.49,76.48 201.3,75.67 J2.A9 ; 200.49,76.48 195.59,81.38 140.03,81.38 NOREF#107.4 134.75,78.1 134.23,78.62 132.47,78.62 131.95,78.1 NOREF#52.3
L_D+: length 51.2
  Bottom Layer w0.2: J1.B6 30.35,74.07 29.54,73.26 29.54,69.44 31.7,67.28 37.8,67.28 ; U6.6 37.8,67.28 37.8,67.28 ; 37.8,67.28 38.36,67.28 43.78,61.86 43.78,54.22 50.9,47.11 50.9,45.35 51.8,44.44 54,44.44 R10.1
  Bottom Layer w0.3: J1.B6 30.35,75.53 30.07,75.81 29.63,75.81 29.35,75.53 J1.A6
L_D-: length 49.4
  Bottom Layer w0.2: 29.13,73.92 29.13,69.28 31.53,66.88 37.81,66.88 ; 37.81,66.88 37.8,66.87 U6.1 ; 37.81,66.88 38.2,66.88 43.38,61.69 43.38,54.06 50.5,46.94 50.5,45.18 51.64,44.04 53.4,44.04 R11.1
  Bottom Layer w0.3: J1.B7 28.85,74.21 29.13,73.92 29.57,73.92 29.85,74.21 J1.A7
L_USB_DM: length 3.1
  Bottom Layer w0.2: R11.2 54.1,42.12 55.72,40.49 U5.46
LED_GATE: length 65
  Top Layer w0.2: NOREF#37.1 169.32,33.37 172.87,33.37 174.53,35.02 174.53,39.21 173.36,40.37 NOREF#92.1 ; NOREF#44.1 55.07,33.37 58.62,33.37 60.28,35.02 60.28,39.21 59.11,40.37 NOREF#123.1
  Bottom Layer w0.2: U5.28 54.53,32.83 NOREF#44.1 ; NOREF#37.1 168.78,32.83 U1.28
LED_SIG: length 50.7
  Bottom Layer w0.2: D9.4 151.42,19.03 158.52,26.13 158.52,27.15 161.32,29.94 164.75,29.94 167.97,33.17 U1.29 ; D3.4 37.17,19.03 44.27,26.13 44.27,27.15 47.07,29.94 50.5,29.94 53.72,33.17 U5.29
LEDGND: length 69
  Bottom Layer w0.4: LMX_SW15.7 R34.2 ; RMX_SW2.7 R51.2 ; RMX_SW16.7 R65.2 ; LMX_SW1.7 R20.2 ; R70.2 RMX_SW21.7 ; LMX_SW3.7 R22.2 ; RMX_SW11.7 R60.2 ; RMX_SW17.7 R66.2 ; LMX_SW5.7 R24.2 ; LMX_SW14.7 R33.2 ; LMX_SW19.7 R38.2 ; RMX_SW13.7 R62.2 ; LMX_SW16.7 R35.2 ; RMX_SW5.7 R54.2 ; LMX_SW13.7 R32.2 ; RMX_SW4.7 R53.2 ; LMX_SW10.7 R29.2 ; RMX_SW22.7 R71.2 ; RMX_SW23.7 R72.2 ; LMX_SW11.7 R30.2 ; RMX_SW20.7 R69.2 ; LMX_SW12.7 R31.2 ; RMX_SW1.7 R50.2 ; LMX_SW22.7 R41.2 ; RMX_SW7.7 R56.2 ; RMX_SW3.7 R52.2 ; RMX_SW18.7 R67.2 ; LMX_SW23.7 R42.2 ; LMX_SW2.7 R21.2 ; RMX_SW12.7 R61.2 ; LMX_SW20.7 R39.2 ; RMX_SW9.7 R58.2 ; LMX_SW6.7 R25.2 ; RMX_SW15.7 R64.2 ; LMX_SW7.7 R26.2 ; RMX_SW8.7 R57.2 ; RMX_SW6.7 R55.2 ; RMX_SW19.7 R68.2 ; LMX_SW21.7 R40.2 ; LMX_SW18.7 R37.2 ; RMX_SW14.7 R63.2 ; LMX_SW4.7 R23.2 ; LMX_SW8.7 R27.2 ; LMX_SW17.7 R36.2 ; RMX_SW10.7 R59.2 ; LMX_SW9.7 R28.2
LMX1: length 65.6
  Bottom Layer w0.2: LMX_SW1.4 19,63.27 19,45.94 27.84,37.1 U5.37
LMX2: length 53.9
  Bottom Layer w0.2: U5.38 33.67,37.5 31.57,39.59 31.57,47.59 24.74,54.43 LMX_SW2.5
LMX3: length 42.5
  Top Layer w0.2: NOREF#99.1 NOREF#97.1
  Bottom Layer w0.2: U5.40 44.54,38.3 39.45,43.39 39.45,58.66 NOREF#97.1 ; LMX_SW3.5 NOREF#99.1
LMX4: length 43.1
  Bottom Layer w0.2: U5.3 67.93,38.3 73.1,43.47 73.1,51.4 69.19,55.31 LMX_SW4.4
